# EasyEDA Pro project Designs.eprj, schematic Schematic11
Board Name: 256byte&16byteMemory; Create Date: 2026-05-11; Page Name: P1; Project Name: Designs; Schematic Name: Schematic11; Update Date: 2026-05-13; Company: EasyEDA.com; Page Size: A4; Version: V1.0
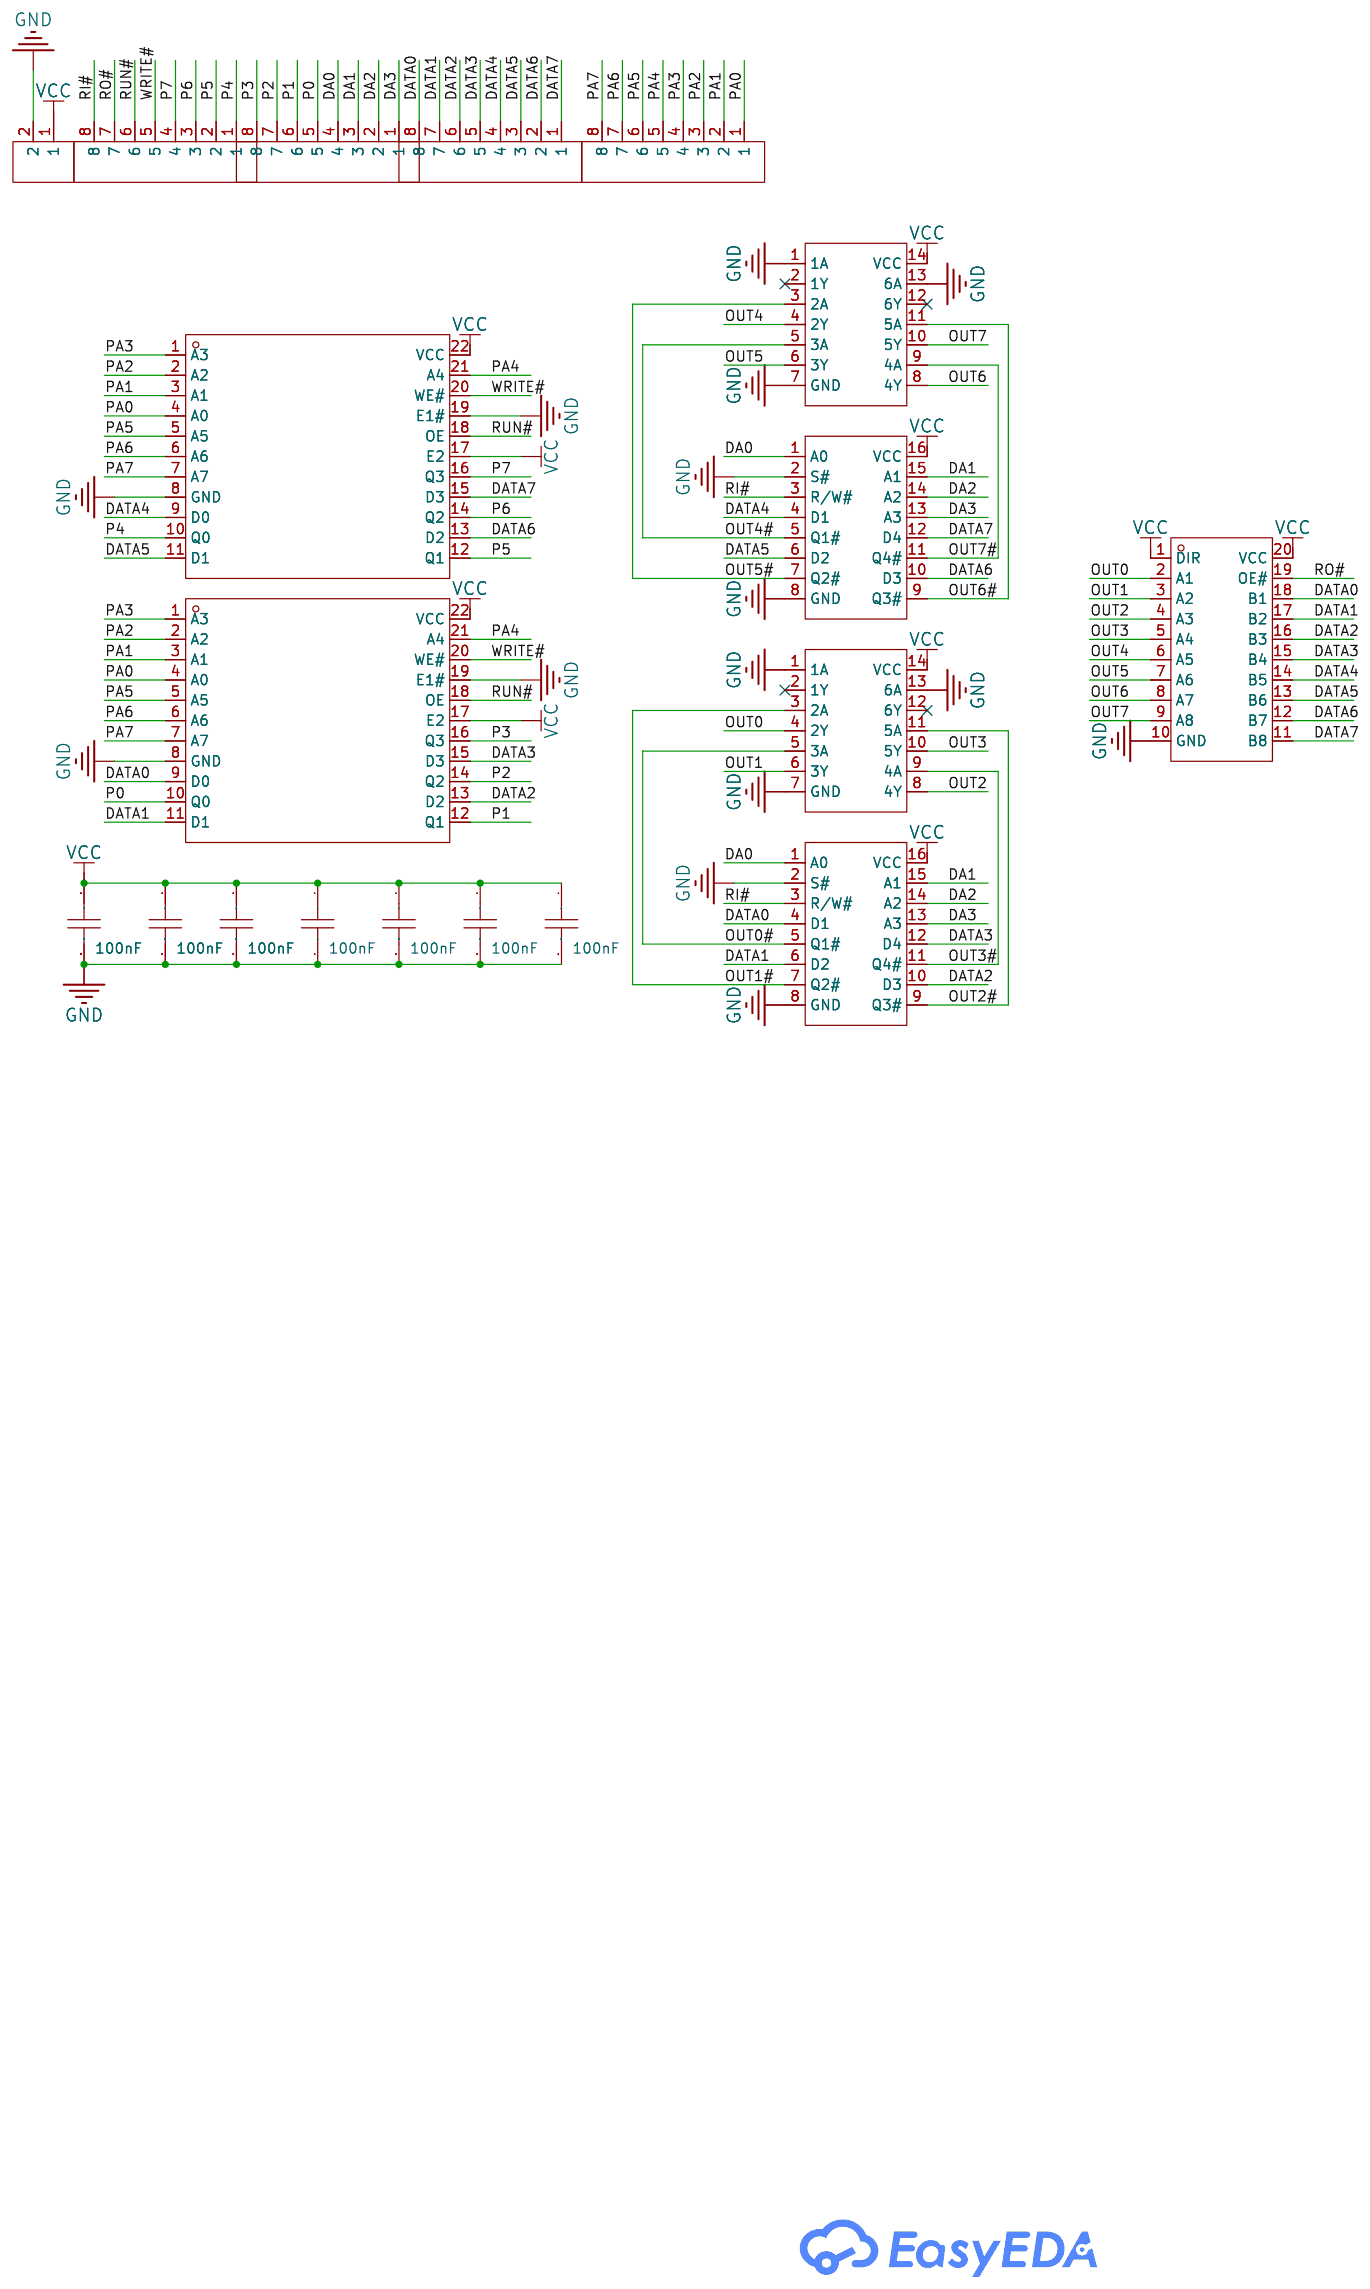
[diagram p8: schematic sheet]

## Parts
C61  100nF  [CAP-TH_L5.0-W2.5-P5.00-D1.0]
C62  100nF  [CAP-TH_L5.0-W2.5-P5.00-D1.0]
C63  100nF  [CAP-TH_L5.0-W2.5-P5.00-D1.0]
C64  100nF  [CAP-TH_L5.0-W2.5-P5.00-D1.0]
C65  100nF  [CAP-TH_L5.0-W2.5-P5.00-D1.0]
C66  100nF  [CAP-TH_L5.0-W2.5-P5.00-D1.0]
C67  100nF  [CAP-TH_L5.0-W2.5-P5.00-D1.0]
U5  SN74HC245N3  [PDIP-20_L25.9-W6.6-P2.54-LS7.9-BL]
U321  SN74HC04N(LX)  [DIP-14_L19.6-W6.4-P2.54-LS7.6-BL]
U378  CD74HC173E  [PDIP-16_L19.2-W6.6-P2.54-LS7.6-BL]
U379  CD74HC173E  [PDIP-16_L19.2-W6.6-P2.54-LS7.6-BL]
U380  SN74HC04N(LX)  [DIP-14_L19.6-W6.4-P2.54-LS7.6-BL]
U389  TH2.54_8P_0.6  [HDR-TH_8P-P2.54-V-M-3]
U390  Jumper2  [HDR-TH_2P-P2.54-V-M-1]
U391  TH2.54_8P_0.6  [HDR-TH_8P-P2.54-V-M-3]
U392  TH2.54_8P_0.6  [HDR-TH_8P-P2.54-V-M-3]
U393  TH2.54_8P_0.6  [HDR-TH_8P-P2.54-V-M-3]
U396  -  [PDIP-22_L28.0-W8.5-P2.54-LS10.1-BL]
U397  -  [PDIP-22_L28.0-W8.5-P2.54-LS10.1-BL]

## Library data of the parts
C61-C67 = 178MU0006: LCSC Part Name: 100nF ±10% 50V; Supplier Part: C5632430; Manufacturer: KNSCHA(科尼盛); Supplier Footprint: 插件,P=2.54mm; JLCPCB Part Class: Extended Part; Datasheet: https://item.szlcsc.com/datasheet/178MU0006/6552585.html; Supplier: LCSC; Tolerance: ±10%; Voltage Rating: 50V; Temperature Coefficient: X7R; Pin Spacing: 2.54mm
U5 = SN74HC245N3: Supplier Part: C3587488; Manufacturer: TI(德州仪器); Supplier Footprint: PDIP-20; JLCPCB Part Class: Extended Part; Datasheet: https://item.szlcsc.com/datasheet/SN74HC245N3/4154202.html; Supplier: LCSC; output type: Tri-State; Voltage - Supply: 2V~6V; Number of Elements: 1; Number of Bits per Element: 8; Channel Type: Bidirectional; Current - Output Low(IOL): 7.8mA; Current - Output High(IOH): 7.8mA; Logic Family: 74HC; Operating Temperature: -40℃~+85℃; Quiescent Current: 80uA; Propagation Delay: 21ns@4.5V,50pF
U321 U380 = SN74HC04N(LX): LCSC Part Name: 集成电路; Supplier Part: C22436641; Manufacturer: LX(灵星芯微); Supplier Footprint: DIP-14; JLCPCB Part Class: Extended Part; Datasheet: https://item.szlcsc.com/datasheet/SN74HC04N(LX)/24070577.html; Supplier: LCSC; Voltage - Supply: 2V~6V; Quiescent Current(Iq): 2uA; Number of Circuits: 6; Input Logic Level - High: 1.5V~4.2V; Input Logic Level -Low: 500mV~1.8V; Output Logic Level - High: 4.4V；5.9V；1.9V; Output Logic Level - Low: 260mV；260mV；100mV; Propagation Delay: 14ns@6V,50pF; Series: 74HC Series; Operating Temperature: -40℃~+125℃
U378 U379 = CD74HC173E: LCSC Part Name: 三态高速CMOS逻辑四路D型触发器; Supplier Part: C1549968; Manufacturer: TI(德州仪器); Supplier Footprint: PDIP-16; JLCPCB Part Class: Extended Part; Datasheet: https://www.ti.com/cn/lit/gpn/cd74hct173; Supplier: LCSC; Type: D-Type; Trigger Type: Rising Edge; Voltage - Supply: 2V~6V; Clock Frequency: 60MHz; Function: Reset; Number of Elements: 1; Number of Bits per Element: 4; Output Type: Tri-State; Propagation Delay: 34ns@6V,50pF; Series: 74HC Series; Current - Output Low(IOL): 7.8mA; Current - Output High(IOH): 7.8mA; Quiescent Current: 8uA; Input Capacitance: 10pF; Operating Temperature: -55℃~+125℃; Setup Time: 12ns; Hold Time: 3ns
U389 U391-U393 = TH2.54_8P_0.6: Supplier Part: C9900018349; Supplier Footprint: HDR-TH-8P; JLCPCB Part Class: Extended Part; Supplier: LCSC
U390 = Jumper2: Supplier Part: C2940092; Supplier Footprint: HDR-TH-2P-2.54mm; JLCPCB Part Class: Extended Part; Supplier: LCSC
U396 U397 = AM9101C

## Nets
GND: C61.2 C62.2 C63.2 C64.2 C65.2 C66.2 C67.2 U5.10(GND) U321.1(1A) U321.7(GND) U321.13(6A) U378.2(S#) U378.8(GND) U379.2(S#) U379.8(GND) U380.1(1A) U380.7(GND) U380.13(6A) U390.2 U396.8(GND) U396.19(E1#) U397.8(GND) U397.19(E1#)
VCC: C61.1 C62.1 C63.1 C64.1 C65.1 C66.1 C67.1 U5.1(DIR) U5.20(VCC) U321.14(VCC) U378.16(VCC) U379.16(VCC) U380.14(VCC) U390.1 U396.17(E2) U396.22(VCC) U397.17(E2) U397.22(VCC)
DA0: U378.1(A0) U379.1(A0) U392.4
DA1: U378.15(A1) U379.15(A1) U392.3
DA2: U378.14(A2) U379.14(A2) U392.2
DA3: U378.13(A3) U379.13(A3) U392.1
DATA0: U5.18(B1) U379.4(D1) U391.8 U397.9(D0)
DATA1: U5.17(B2) U379.6(D2) U391.7 U397.11(D1)
DATA2: U5.16(B3) U379.10(D3) U391.6 U397.13(D2)
DATA3: U5.15(B4) U379.12(D4) U391.5 U397.15(D3)
DATA4: U5.14(B5) U378.4(D1) U391.4 U396.9(D0)
DATA5: U5.13(B6) U378.6(D2) U391.3 U396.11(D1)
DATA6: U5.12(B7) U378.10(D3) U391.2 U396.13(D2)
DATA7: U5.11(B8) U378.12(D4) U391.1 U396.15(D3)
OUT0: U5.2(A1) U380.4(2Y)
OUT0#: U379.5(Q1#) U380.5(3A)
OUT1: U5.3(A2) U380.6(3Y)
OUT1#: U379.7(Q2#) U380.3(2A)
OUT2: U5.4(A3) U380.8(4Y)
OUT2#: U379.9(Q3#) U380.11(5A)
OUT3: U5.5(A4) U380.10(5Y)
OUT3#: U379.11(Q4#) U380.9(4A)
OUT4: U5.6(A5) U321.4(2Y)
OUT4#: U321.5(3A) U378.5(Q1#)
OUT5: U5.7(A6) U321.6(3Y)
OUT5#: U321.3(2A) U378.7(Q2#)
OUT6: U5.8(A7) U321.8(4Y)
OUT6#: U321.11(5A) U378.9(Q3#)
OUT7: U5.9(A8) U321.10(5Y)
OUT7#: U321.9(4A) U378.11(Q4#)
P0: U392.5 U397.10(Q0)
P1: U392.6 U397.12(Q1)
P2: U392.7 U397.14(Q2)
P3: U392.8 U397.16(Q3)
P4: U393.1 U396.10(Q0)
P5: U393.2 U396.12(Q1)
P6: U393.3 U396.14(Q2)
P7: U393.4 U396.16(Q3)
PA0: U389.1 U396.4(A0) U397.4(A0)
PA1: U389.2 U396.3(A1) U397.3(A1)
PA2: U389.3 U396.2(A2) U397.2(A2)
PA3: U389.4 U396.1(A3) U397.1(A3)
PA4: U389.5 U396.21(A4) U397.21(A4)
PA5: U389.6 U396.5(A5) U397.5(A5)
PA6: U389.7 U396.6(A6) U397.6(A6)
PA7: U389.8 U396.7(A7) U397.7(A7)
RI#: U378.3(R/W#) U379.3(R/W#) U393.8
RO#: U5.19(OE#) U393.7
RUN#: U393.6 U396.18(OE) U397.18(OE)
WRITE#: U393.5 U396.20(WE#) U397.20(WE#)

Not connected (* = marked no-connect by the designer): U321 2(1Y)* 12(6Y)*; U380 2(1Y)* 12(6Y)*
